# Altium schematic sheet GridSeed.SchDoc (part 1 of 2) (continued)
## Parts (continued)
C278  DB_VALUE: 470nF  [SMD_0603_CAPC1608X95N]
C279  DB_VALUE: 470nF  [SMD_0603_CAPC1608X95N]
C280  DB_VALUE: 470nF  [SMD_0603_CAPC1608X95N]
C281  DB_VALUE: 470nF  [SMD_0603_CAPC1608X95N]
C282  DB_VALUE: 470nF  [SMD_0603_CAPC1608X95N]
C283  DB_VALUE: 470nF  [SMD_0603_CAPC1608X95N]
C284  DB_VALUE: 470nF  [SMD_0603_CAPC1608X95N]
C285  DB_VALUE: 470nF  [SMD_0603_CAPC1608X95N]
C286  DB_VALUE: 470nF  [SMD_0603_CAPC1608X95N]
C287  DB_VALUE: 470nF  [SMD_0603_CAPC1608X95N]
C288  DB_VALUE: 470nF  [SMD_0603_CAPC1608X95N]
C289  DB_VALUE: 470nF  [SMD_0603_CAPC1608X95N]
C290  DB_VALUE: 470nF  [SMD_0603_CAPC1608X95N]
C291  DB_VALUE: 470nF  [SMD_0603_CAPC1608X95N]
C292  DB_VALUE: 2.2uF  DB_TOLERANCE: 5%  DB_VOLTAGE: 10V  [SMD_0805_CAPC2012X145N]
C293  DB_VALUE: 100pF  DB_TOLERANCE: 5%  DB_VOLTAGE: 50V  [SMD_0805_CAPC2012X145N]
C294  DB_VALUE: 47pF  DB_TOLERANCE: 5%  DB_VOLTAGE: 50V  [SMD_0805_CAPC2012X145N]
C295  DB_VALUE: 22pF  DB_TOLERANCE: 5%  DB_VOLTAGE: 50V  [SMD_0805_CAPC2012X145N]
C296  DB_VALUE: 2.2uF  DB_TOLERANCE: 5%  DB_VOLTAGE: 10V  [SMD_0805_CAPC2012X145N]
C297  DB_VALUE: 100pF  DB_TOLERANCE: 5%  DB_VOLTAGE: 50V  [SMD_0805_CAPC2012X145N]
C298  DB_VALUE: 47pF  DB_TOLERANCE: 5%  DB_VOLTAGE: 50V  [SMD_0805_CAPC2012X145N]
C299  DB_VALUE: 22pF  DB_TOLERANCE: 5%  DB_VOLTAGE: 50V  [SMD_0805_CAPC2012X145N]
C300  DB_VALUE: 2.2uF  DB_TOLERANCE: 5%  DB_VOLTAGE: 10V  [SMD_0805_CAPC2012X145N]
C301  DB_VALUE: 100pF  DB_TOLERANCE: 5%  DB_VOLTAGE: 50V  [SMD_0805_CAPC2012X145N]
C302  DB_VALUE: 47pF  DB_TOLERANCE: 5%  DB_VOLTAGE: 50V  [SMD_0805_CAPC2012X145N]
C303  DB_VALUE: 22pF  DB_TOLERANCE: 5%  DB_VOLTAGE: 50V  [SMD_0805_CAPC2012X145N]
C304  DB_VALUE: 2.2uF  DB_TOLERANCE: 5%  DB_VOLTAGE: 10V  [SMD_0805_CAPC2012X145N]
C305  DB_VALUE: 100pF  DB_TOLERANCE: 5%  DB_VOLTAGE: 50V  [SMD_0805_CAPC2012X145N]
C306  DB_VALUE: 47pF  DB_TOLERANCE: 5%  DB_VOLTAGE: 50V  [SMD_0805_CAPC2012X145N]
C307  DB_VALUE: 22pF  DB_TOLERANCE: 5%  DB_VOLTAGE: 50V  [SMD_0805_CAPC2012X145N]
C308  DB_VALUE: 2.2uF  DB_TOLERANCE: 5%  DB_VOLTAGE: 10V  [SMD_0805_CAPC2012X145N]
C309  DB_VALUE: 100pF  DB_TOLERANCE: 5%  DB_VOLTAGE: 50V  [SMD_0805_CAPC2012X145N]
C310  DB_VALUE: 47pF  DB_TOLERANCE: 5%  DB_VOLTAGE: 50V  [SMD_0805_CAPC2012X145N]
C311  DB_VALUE: 22pF  DB_TOLERANCE: 5%  DB_VOLTAGE: 50V  [SMD_0805_CAPC2012X145N]
C312  DB_VALUE: 2.2uF  DB_TOLERANCE: 5%  DB_VOLTAGE: 10V  [SMD_0805_CAPC2012X145N]
C313  DB_VALUE: 100pF  DB_TOLERANCE: 5%  DB_VOLTAGE: 50V  [SMD_0805_CAPC2012X145N]
C314  DB_VALUE: 47pF  DB_TOLERANCE: 5%  DB_VOLTAGE: 50V  [SMD_0805_CAPC2012X145N]
C315  DB_VALUE: 22pF  DB_TOLERANCE: 5%  DB_VOLTAGE: 50V  [SMD_0805_CAPC2012X145N]
C316  DB_VALUE: 2.2uF  DB_TOLERANCE: 5%  DB_VOLTAGE: 10V  [SMD_0805_CAPC2012X145N]
C317  DB_VALUE: 100pF  DB_TOLERANCE: 5%  DB_VOLTAGE: 50V  [SMD_0805_CAPC2012X145N]
C318  DB_VALUE: 47pF  DB_TOLERANCE: 5%  DB_VOLTAGE: 50V  [SMD_0805_CAPC2012X145N]
C319  DB_VALUE: 22pF  DB_TOLERANCE: 5%  DB_VOLTAGE: 50V  [SMD_0805_CAPC2012X145N]
C320  DB_VALUE: 2.2uF  DB_TOLERANCE: 5%  DB_VOLTAGE: 10V  [SMD_0805_CAPC2012X145N]
C321  DB_VALUE: 100pF  DB_TOLERANCE: 5%  DB_VOLTAGE: 50V  [SMD_0805_CAPC2012X145N]
C322  DB_VALUE: 47pF  DB_TOLERANCE: 5%  DB_VOLTAGE: 50V  [SMD_0805_CAPC2012X145N]
C323  DB_VALUE: 22pF  DB_TOLERANCE: 5%  DB_VOLTAGE: 50V  [SMD_0805_CAPC2012X145N]
C324  DB_VALUE: 470nF  [SMD_0603_CAPC1608X95N]
C325  DB_VALUE: 470nF  [SMD_0603_CAPC1608X95N]
C326  DB_VALUE: 470nF  [SMD_0603_CAPC1608X95N]
C327  DB_VALUE: 470nF  [SMD_0603_CAPC1608X95N]
C328  DB_VALUE: 470nF  [SMD_0603_CAPC1608X95N]
C329  DB_VALUE: 470nF  [SMD_0603_CAPC1608X95N]
C330  DB_VALUE: 470nF  [SMD_0603_CAPC1608X95N]
C331  DB_VALUE: 470nF  [SMD_0603_CAPC1608X95N]
C332  DB_VALUE: 470nF  [SMD_0603_CAPC1608X95N]
C333  DB_VALUE: 470nF  [SMD_0603_CAPC1608X95N]
C334  DB_VALUE: 470nF  [SMD_0603_CAPC1608X95N]
C335  DB_VALUE: 470nF  [SMD_0603_CAPC1608X95N]
C336  DB_VALUE: 470nF  [SMD_0603_CAPC1608X95N]
C337  DB_VALUE: 470nF  [SMD_0603_CAPC1608X95N]
C338  DB_VALUE: 470nF  [SMD_0603_CAPC1608X95N]
C339  DB_VALUE: 470nF  [SMD_0603_CAPC1608X95N]
C340  DB_VALUE: 470nF  [SMD_0603_CAPC1608X95N]
C341  DB_VALUE: 470nF  [SMD_0603_CAPC1608X95N]
C342  DB_VALUE: 470nF  [SMD_0603_CAPC1608X95N]
C343  DB_VALUE: 470nF  [SMD_0603_CAPC1608X95N]
C344  DB_VALUE: 470nF  [SMD_0603_CAPC1608X95N]
C345  DB_VALUE: 470nF  [SMD_0603_CAPC1608X95N]
C346  DB_VALUE: 470nF  [SMD_0603_CAPC1608X95N]
C347  DB_VALUE: 470nF  [SMD_0603_CAPC1608X95N]
C348  DB_VALUE: 470nF  [SMD_0603_CAPC1608X95N]
C349  DB_VALUE: 470nF  [SMD_0603_CAPC1608X95N]
C350  DB_VALUE: 470nF  [SMD_0603_CAPC1608X95N]
C351  DB_VALUE: 470nF  [SMD_0603_CAPC1608X95N]
C352  DB_VALUE: 470nF  [SMD_0603_CAPC1608X95N]
C353  DB_VALUE: 470nF  [SMD_0603_CAPC1608X95N]
C354  DB_VALUE: 470nF  [SMD_0603_CAPC1608X95N]
C355  DB_VALUE: 470nF  [SMD_0603_CAPC1608X95N]
C356  DB_VALUE: 470nF  [SMD_0603_CAPC1608X95N]
C357  DB_VALUE: 470nF  [SMD_0603_CAPC1608X95N]
C358  DB_VALUE: 470nF  [SMD_0603_CAPC1608X95N]
C359  DB_VALUE: 470nF  [SMD_0603_CAPC1608X95N]
C360  DB_VALUE: 470nF  [SMD_0603_CAPC1608X95N]
C361  DB_VALUE: 470nF  [SMD_0603_CAPC1608X95N]
C362  DB_VALUE: 470nF  [SMD_0603_CAPC1608X95N]
C363  DB_VALUE: 470nF  [SMD_0603_CAPC1608X95N]
C364  DB_VALUE: 470nF  [SMD_0603_CAPC1608X95N]
C365  DB_VALUE: 470nF  [SMD_0603_CAPC1608X95N]
C366  DB_VALUE: 470nF  [SMD_0603_CAPC1608X95N]
C367  DB_VALUE: 470nF  [SMD_0603_CAPC1608X95N]
C368  DB_VALUE: 470nF  [SMD_0603_CAPC1608X95N]
C369  DB_VALUE: 470nF  [SMD_0603_CAPC1608X95N]
C370  DB_VALUE: 470nF  [SMD_0603_CAPC1608X95N]
C371  DB_VALUE: 470nF  [SMD_0603_CAPC1608X95N]
C372  DB_VALUE: 470nF  [SMD_0603_CAPC1608X95N]
C373  DB_VALUE: 470nF  [SMD_0603_CAPC1608X95N]
C374  DB_VALUE: 470nF  [SMD_0603_CAPC1608X95N]
C375  DB_VALUE: 470nF  [SMD_0603_CAPC1608X95N]
C376  DB_VALUE: 470nF  [SMD_0603_CAPC1608X95N]
C377  DB_VALUE: 470nF  [SMD_0603_CAPC1608X95N]
C378  DB_VALUE: 470nF  [SMD_0603_CAPC1608X95N]
C379  DB_VALUE: 470nF  [SMD_0603_CAPC1608X95N]
C380  DB_VALUE: 470nF  [SMD_0603_CAPC1608X95N]
C381  DB_VALUE: 470nF  [SMD_0603_CAPC1608X95N]
C382  DB_VALUE: 470nF  [SMD_0603_CAPC1608X95N]
C383  DB_VALUE: 470nF  [SMD_0603_CAPC1608X95N]
C384  DB_VALUE: 2.2uF  DB_TOLERANCE: 5%  DB_VOLTAGE: 10V  [SMD_0805_CAPC2012X145N]
C385  DB_VALUE: 100pF  DB_TOLERANCE: 5%  DB_VOLTAGE: 50V  [SMD_0805_CAPC2012X145N]
C386  DB_VALUE: 47pF  DB_TOLERANCE: 5%  DB_VOLTAGE: 50V  [SMD_0805_CAPC2012X145N]
C387  DB_VALUE: 22pF  DB_TOLERANCE: 5%  DB_VOLTAGE: 50V  [SMD_0805_CAPC2012X145N]
C388  DB_VALUE: 2.2uF  DB_TOLERANCE: 5%  DB_VOLTAGE: 10V  [SMD_0805_CAPC2012X145N]
C389  DB_VALUE: 100pF  DB_TOLERANCE: 5%  DB_VOLTAGE: 50V  [SMD_0805_CAPC2012X145N]
C390  DB_VALUE: 47pF  DB_TOLERANCE: 5%  DB_VOLTAGE: 50V  [SMD_0805_CAPC2012X145N]
C391  DB_VALUE: 22pF  DB_TOLERANCE: 5%  DB_VOLTAGE: 50V  [SMD_0805_CAPC2012X145N]
C392  DB_VALUE: 2.2uF  DB_TOLERANCE: 5%  DB_VOLTAGE: 10V  [SMD_0805_CAPC2012X145N]
C393  DB_VALUE: 100pF  DB_TOLERANCE: 5%  DB_VOLTAGE: 50V  [SMD_0805_CAPC2012X145N]
C394  DB_VALUE: 47pF  DB_TOLERANCE: 5%  DB_VOLTAGE: 50V  [SMD_0805_CAPC2012X145N]
C395  DB_VALUE: 22pF  DB_TOLERANCE: 5%  DB_VOLTAGE: 50V  [SMD_0805_CAPC2012X145N]
C396  DB_VALUE: 2.2uF  DB_TOLERANCE: 5%  DB_VOLTAGE: 10V  [SMD_0805_CAPC2012X145N]
C397  DB_VALUE: 100pF  DB_TOLERANCE: 5%  DB_VOLTAGE: 50V  [SMD_0805_CAPC2012X145N]
C398  DB_VALUE: 47pF  DB_TOLERANCE: 5%  DB_VOLTAGE: 50V  [SMD_0805_CAPC2012X145N]
C399  DB_VALUE: 22pF  DB_TOLERANCE: 5%  DB_VOLTAGE: 50V  [SMD_0805_CAPC2012X145N]
C400  DB_VALUE: 2.2uF  DB_TOLERANCE: 5%  DB_VOLTAGE: 10V  [SMD_0805_CAPC2012X145N]
C401  DB_VALUE: 100pF  DB_TOLERANCE: 5%  DB_VOLTAGE: 50V  [SMD_0805_CAPC2012X145N]
C402  DB_VALUE: 47pF  DB_TOLERANCE: 5%  DB_VOLTAGE: 50V  [SMD_0805_CAPC2012X145N]
C403  DB_VALUE: 22pF  DB_TOLERANCE: 5%  DB_VOLTAGE: 50V  [SMD_0805_CAPC2012X145N]
C404  DB_VALUE: 2.2uF  DB_TOLERANCE: 5%  DB_VOLTAGE: 10V  [SMD_0805_CAPC2012X145N]
C405  DB_VALUE: 100pF  DB_TOLERANCE: 5%  DB_VOLTAGE: 50V  [SMD_0805_CAPC2012X145N]
C406  DB_VALUE: 47pF  DB_TOLERANCE: 5%  DB_VOLTAGE: 50V  [SMD_0805_CAPC2012X145N]
C407  DB_VALUE: 22pF  DB_TOLERANCE: 5%  DB_VOLTAGE: 50V  [SMD_0805_CAPC2012X145N]
C408  DB_VALUE: 2.2uF  DB_TOLERANCE: 5%  DB_VOLTAGE: 10V  [SMD_0805_CAPC2012X145N]
C409  DB_VALUE: 100pF  DB_TOLERANCE: 5%  DB_VOLTAGE: 50V  [SMD_0805_CAPC2012X145N]
C410  DB_VALUE: 47pF  DB_TOLERANCE: 5%  DB_VOLTAGE: 50V  [SMD_0805_CAPC2012X145N]
C411  DB_VALUE: 22pF  DB_TOLERANCE: 5%  DB_VOLTAGE: 50V  [SMD_0805_CAPC2012X145N]
C412  DB_VALUE: 2.2uF  DB_TOLERANCE: 5%  DB_VOLTAGE: 10V  [SMD_0805_CAPC2012X145N]
C413  DB_VALUE: 100pF  DB_TOLERANCE: 5%  DB_VOLTAGE: 50V  [SMD_0805_CAPC2012X145N]
C414  DB_VALUE: 47pF  DB_TOLERANCE: 5%  DB_VOLTAGE: 50V  [SMD_0805_CAPC2012X145N]
C415  DB_VALUE: 22pF  DB_TOLERANCE: 5%  DB_VOLTAGE: 50V  [SMD_0805_CAPC2012X145N]
C_1  DB_VALUE: 220uF  DB_TOLERANCE: 20%  DB_VOLTAGE: 6.3V  [SMD_1210_CAPC3225X270N]
C_2  DB_VALUE: 220uF  DB_TOLERANCE: 20%  DB_VOLTAGE: 6.3V  [SMD_1210_CAPC3225X270N]
C_3  DB_VALUE: 220uF  DB_TOLERANCE: 20%  DB_VOLTAGE: 6.3V  [SMD_1210_CAPC3225X270N]
C_4  DB_VALUE: 220uF  DB_TOLERANCE: 20%  DB_VOLTAGE: 6.3V  [SMD_1210_CAPC3225X270N]
C_5  DB_VALUE: 220uF  DB_TOLERANCE: 20%  DB_VOLTAGE: 6.3V  [SMD_1210_CAPC3225X270N]
C_6  DB_VALUE: 220uF  DB_TOLERANCE: 20%  DB_VOLTAGE: 6.3V  [SMD_1210_CAPC3225X270N]
C_7  DB_VALUE: 220uF  DB_TOLERANCE: 20%  DB_VOLTAGE: 6.3V  [SMD_1210_CAPC3225X270N]
C_8  DB_VALUE: 220uF  DB_TOLERANCE: 20%  DB_VOLTAGE: 6.3V  [SMD_1210_CAPC3225X270N]
C_9  DB_VALUE: 220uF  DB_TOLERANCE: 20%  DB_VOLTAGE: 6.3V  [SMD_1210_CAPC3225X270N]
C_10  DB_VALUE: 220uF  DB_TOLERANCE: 20%  DB_VOLTAGE: 6.3V  [SMD_1210_CAPC3225X270N]
C_11  DB_VALUE: 220uF  DB_TOLERANCE: 20%  DB_VOLTAGE: 6.3V  [SMD_1210_CAPC3225X270N]
C_12  DB_VALUE: 220uF  DB_TOLERANCE: 20%  DB_VOLTAGE: 6.3V  [SMD_1210_CAPC3225X270N]
C_13  DB_VALUE: 220uF  DB_TOLERANCE: 20%  DB_VOLTAGE: 6.3V  [SMD_1210_CAPC3225X270N]
C_14  DB_VALUE: 220uF  DB_TOLERANCE: 20%  DB_VOLTAGE: 6.3V  [SMD_1210_CAPC3225X270N]
C_15  DB_VALUE: 220uF  DB_TOLERANCE: 20%  DB_VOLTAGE: 6.3V  [SMD_1210_CAPC3225X270N]
C_16  DB_VALUE: 220uF  DB_TOLERANCE: 20%  DB_VOLTAGE: 6.3V  [SMD_1210_CAPC3225X270N]
C_17  DB_VALUE: 220uF  DB_TOLERANCE: 20%  DB_VOLTAGE: 6.3V  [SMD_1210_CAPC3225X270N]
C_18  DB_VALUE: 220uF  DB_TOLERANCE: 20%  DB_VOLTAGE: 6.3V  [SMD_1210_CAPC3225X270N]
C_19  DB_VALUE: 220uF  DB_TOLERANCE: 20%  DB_VOLTAGE: 6.3V  [SMD_1210_CAPC3225X270N]
C_20  DB_VALUE: 220uF  DB_TOLERANCE: 20%  DB_VOLTAGE: 6.3V  [SMD_1210_CAPC3225X270N]
C_21  DB_VALUE: 220uF  DB_TOLERANCE: 20%  DB_VOLTAGE: 6.3V  [SMD_1210_CAPC3225X270N]
C_22  DB_VALUE: 220uF  DB_TOLERANCE: 20%  DB_VOLTAGE: 6.3V  [SMD_1210_CAPC3225X270N]
C_23  DB_VALUE: 220uF  DB_TOLERANCE: 20%  DB_VOLTAGE: 6.3V  [SMD_1210_CAPC3225X270N]
C_24  DB_VALUE: 220uF  DB_TOLERANCE: 20%  DB_VOLTAGE: 6.3V  [SMD_1210_CAPC3225X270N]
C_25  DB_VALUE: 220uF  DB_TOLERANCE: 20%  DB_VOLTAGE: 6.3V  [SMD_1210_CAPC3225X270N]
C_26  DB_VALUE: 220uF  DB_TOLERANCE: 20%  DB_VOLTAGE: 6.3V  [SMD_1210_CAPC3225X270N]
C_27  DB_VALUE: 220uF  DB_TOLERANCE: 20%  DB_VOLTAGE: 6.3V  [SMD_1210_CAPC3225X270N]
C_28  DB_VALUE: 220uF  DB_TOLERANCE: 20%  DB_VOLTAGE: 6.3V  [SMD_1210_CAPC3225X270N]
C_29  DB_VALUE: 220uF  DB_TOLERANCE: 20%  DB_VOLTAGE: 6.3V  [SMD_1210_CAPC3225X270N]
C_30  DB_VALUE: 220uF  DB_TOLERANCE: 20%  DB_VOLTAGE: 6.3V  [SMD_1210_CAPC3225X270N]
C_31  DB_VALUE: 220uF  DB_TOLERANCE: 20%  DB_VOLTAGE: 6.3V  [SMD_1210_CAPC3225X270N]
C_32  DB_VALUE: 220uF  DB_TOLERANCE: 20%  DB_VOLTAGE: 6.3V  [SMD_1210_CAPC3225X270N]
C_33  DB_VALUE: 220uF  DB_TOLERANCE: 20%  DB_VOLTAGE: 6.3V  [SMD_1210_CAPC3225X270N]
C_34  DB_VALUE: 220uF  DB_TOLERANCE: 20%  DB_VOLTAGE: 6.3V  [SMD_1210_CAPC3225X270N]
C_35  DB_VALUE: 220uF  DB_TOLERANCE: 20%  DB_VOLTAGE: 6.3V  [SMD_1210_CAPC3225X270N]
C_36  DB_VALUE: 220uF  DB_TOLERANCE: 20%  DB_VOLTAGE: 6.3V  [SMD_1210_CAPC3225X270N]
C_37  DB_VALUE: 220uF  DB_TOLERANCE: 20%  DB_VOLTAGE: 6.3V  [SMD_1210_CAPC3225X270N]
C_38  DB_VALUE: 220uF  DB_TOLERANCE: 20%  DB_VOLTAGE: 6.3V  [SMD_1210_CAPC3225X270N]
C_39  DB_VALUE: 220uF  DB_TOLERANCE: 20%  DB_VOLTAGE: 6.3V  [SMD_1210_CAPC3225X270N]
C_40  DB_VALUE: 220uF  DB_TOLERANCE: 20%  DB_VOLTAGE: 6.3V  [SMD_1210_CAPC3225X270N]
C_41  DB_VALUE: 220uF  DB_TOLERANCE: 20%  DB_VOLTAGE: 6.3V  [SMD_1210_CAPC3225X270N]
C_42  DB_VALUE: 220uF  DB_TOLERANCE: 20%  DB_VOLTAGE: 6.3V  [SMD_1210_CAPC3225X270N]
C_43  DB_VALUE: 220uF  DB_TOLERANCE: 20%  DB_VOLTAGE: 6.3V  [SMD_1210_CAPC3225X270N]
C_44  DB_VALUE: 220uF  DB_TOLERANCE: 20%  DB_VOLTAGE: 6.3V  [SMD_1210_CAPC3225X270N]
C_45  DB_VALUE: 220uF  DB_TOLERANCE: 20%  DB_VOLTAGE: 6.3V  [SMD_1210_CAPC3225X270N]
C_46  DB_VALUE: 220uF  DB_TOLERANCE: 20%  DB_VOLTAGE: 6.3V  [SMD_1210_CAPC3225X270N]
C_47  DB_VALUE: 220uF  DB_TOLERANCE: 20%  DB_VOLTAGE: 6.3V  [SMD_1210_CAPC3225X270N]
C_48  DB_VALUE: 220uF  DB_TOLERANCE: 20%  DB_VOLTAGE: 6.3V  [SMD_1210_CAPC3225X270N]
C_49  DB_VALUE: 220uF  DB_TOLERANCE: 20%  DB_VOLTAGE: 6.3V  [SMD_1210_CAPC3225X270N]
C_50  DB_VALUE: 220uF  DB_TOLERANCE: 20%  DB_VOLTAGE: 6.3V  [SMD_1210_CAPC3225X270N]
C_51  DB_VALUE: 220uF  DB_TOLERANCE: 20%  DB_VOLTAGE: 6.3V  [SMD_1210_CAPC3225X270N]
C_52  DB_VALUE: 220uF  DB_TOLERANCE: 20%  DB_VOLTAGE: 6.3V  [SMD_1210_CAPC3225X270N]
C_53  DB_VALUE: 220uF  DB_TOLERANCE: 20%  DB_VOLTAGE: 6.3V  [SMD_1210_CAPC3225X270N]
C_54  DB_VALUE: 220uF  DB_TOLERANCE: 20%  DB_VOLTAGE: 6.3V  [SMD_1210_CAPC3225X270N]
C_55  DB_VALUE: 220uF  DB_TOLERANCE: 20%  DB_VOLTAGE: 6.3V  [SMD_1210_CAPC3225X270N]
C_56  DB_VALUE: 220uF  DB_TOLERANCE: 20%  DB_VOLTAGE: 6.3V  [SMD_1210_CAPC3225X270N]
C_57  DB_VALUE: 220uF  DB_TOLERANCE: 20%  DB_VOLTAGE: 6.3V  [SMD_1210_CAPC3225X270N]
C_58  DB_VALUE: 220uF  DB_TOLERANCE: 20%  DB_VOLTAGE: 6.3V  [SMD_1210_CAPC3225X270N]
C_59  DB_VALUE: 220uF  DB_TOLERANCE: 20%  DB_VOLTAGE: 6.3V  [SMD_1210_CAPC3225X270N]
C_60  DB_VALUE: 220uF  DB_TOLERANCE: 20%  DB_VOLTAGE: 6.3V  [SMD_1210_CAPC3225X270N]
C_61  DB_VALUE: 220uF  DB_TOLERANCE: 20%  DB_VOLTAGE: 6.3V  [SMD_1210_CAPC3225X270N]
C_62  DB_VALUE: 220uF  DB_TOLERANCE: 20%  DB_VOLTAGE: 6.3V  [SMD_1210_CAPC3225X270N]
C_63  DB_VALUE: 220uF  DB_TOLERANCE: 20%  DB_VOLTAGE: 6.3V  [SMD_1210_CAPC3225X270N]
C_64  DB_VALUE: 220uF  DB_TOLERANCE: 20%  DB_VOLTAGE: 6.3V  [SMD_1210_CAPC3225X270N]
C_65  DB_VALUE: 220uF  DB_TOLERANCE: 20%  DB_VOLTAGE: 6.3V  [SMD_1210_CAPC3225X270N]
C_66  DB_VALUE: 220uF  DB_TOLERANCE: 20%  DB_VOLTAGE: 6.3V  [SMD_1210_CAPC3225X270N]
C_67  DB_VALUE: 220uF  DB_TOLERANCE: 20%  DB_VOLTAGE: 6.3V  [SMD_1210_CAPC3225X270N]
C_68  DB_VALUE: 220uF  DB_TOLERANCE: 20%  DB_VOLTAGE: 6.3V  [SMD_1210_CAPC3225X270N]
C_69  DB_VALUE: 220uF  DB_TOLERANCE: 20%  DB_VOLTAGE: 6.3V  [SMD_1210_CAPC3225X270N]
C_70  DB_VALUE: 220uF  DB_TOLERANCE: 20%  DB_VOLTAGE: 6.3V  [SMD_1210_CAPC3225X270N]
C_71  DB_VALUE: 220uF  DB_TOLERANCE: 20%  DB_VOLTAGE: 6.3V  [SMD_1210_CAPC3225X270N]
C_72  DB_VALUE: 220uF  DB_TOLERANCE: 20%  DB_VOLTAGE: 6.3V  [SMD_1210_CAPC3225X270N]
D1  BAT54C  [SMD_SOT23_SOT95P240X120-3N]
D2  BAT54C  [SMD_SOT23_SOT95P240X120-3N]
D3  BAT54C  [SMD_SOT23_SOT95P240X120-3N]
D4  Red SML210VT ROHM  [SMD_0805_LED2012X100N]
D5  Green 	SML210MT ROHM  [SMD_0805_LED2012X100N]
D6  Yellow SML210YT ROHM  [SMD_0805_LED2012X100N]
D7  Orange 	SML210DT ROHM  [SMD_0805_LED2012X100N]
D8  (OPT)SS14  DB_VALUE: B140  [SMD_DO214AC_SMA]
D9  SMS05T1G  [SMD_SOT457_SOT95P275X110-6N]
D10  (OPT)SS14  DB_VALUE: B140  [SMD_DO214AC_SMA]
D11  SS14  DB_VALUE: B140  [SMD_DO214AC_SMA]
D12  D_TVS_UNI  DB_VALUE: SMCJ12A  [SMD_DO214AC_SMC]
FB1  L_FERRITE_BEAD  DB_VALUE: 220 Ohms  DB_CURRENT: 2A  [SMD_0805_INDC2012X105N]
J1  CON_5PINS  DB_VALUE: CONN PCB 5P M S  [PTH_HDRV05W64P254_1X05]
J2  CU04SCM15B0-R0  DB_VALUE: USB MINI  [SMD_CON-CVILUX-CU04-SCM15B0]
J3  DB_VALUE: HD-351-3P  [PTH_CON_HD-351-3P]
J4  CON_2ROWS_6PINS_1  DB_VALUE: WR-MPC4  [PTH_CON_WR-MRC4-6P]
L1  SLC1480-201MLD  [SMT_INDM135130X800N]
L2  SLC1480-201MLD  [SMT_INDM135130X800N]
L3  SLC1480-201MLD  [SMT_INDM135130X800N]
Q1  AP1RA03GMT-3  DB_VALUE: AP1RA03GMT-HF-3  [SMD_QFN127P500X600X90-8N]
Q2  AP1RA03GMT-3  DB_VALUE: AP1RA03GMT-HF-3  [SMD_QFN127P500X600X90-8N]
Q3  AP1RA03GMT-3  DB_VALUE: AP1RA03GMT-HF-3  [SMD_QFN127P500X600X90-8N]
Q4  AP1RA03GMT-3  DB_VALUE: AP1RA03GMT-HF-3  [SMD_QFN127P500X600X90-8N]
Q5  AP1RA03GMT-3  DB_VALUE: AP1RA03GMT-HF-3  [SMD_QFN127P500X600X90-8N]
Q6  AP1RA03GMT-3  DB_VALUE: AP1RA03GMT-HF-3  [SMD_QFN127P500X600X90-8N]
Q7  AP1RA03GMT-3  DB_VALUE: AP1RA03GMT-HF-3  [SMD_QFN127P500X600X90-8N]
Q8  AP1RA03GMT-3  DB_VALUE: AP1RA03GMT-HF-3  [SMD_QFN127P500X600X90-8N]
Q9  AP1RA03GMT-3  DB_VALUE: AP1RA03GMT-HF-3  [SMD_QFN127P500X600X90-8N]
R1  DB_VALUE: 10k  DB_TOLERANCE: 1%  [SMD_0603_RESC1608X55N]
R2  DB_VALUE: 10k  DB_TOLERANCE: 1%  [SMD_0603_RESC1608X55N]
R3  DB_VALUE: 10k  DB_TOLERANCE: 1%  [SMD_0603_RESC1608X55N]
R4  DB_VALUE: 10k  DB_TOLERANCE: 1%  [SMD_0603_RESC1608X55N]
R5  DB_VALUE: 10k  DB_TOLERANCE: 1%  [SMD_0603_RESC1608X55N]
R6  DB_VALUE: 10k  DB_TOLERANCE: 1%  [SMD_0603_RESC1608X55N]
R7  DB_VALUE: 10k  DB_TOLERANCE: 1%  [SMD_0603_RESC1608X55N]
R8  DB_VALUE: 10k  DB_TOLERANCE: 1%  [SMD_0603_RESC1608X55N]
R9  DB_VALUE: 1.02R  DB_TOLERANCE: 1%  [SMD_0603_RESC1608X55N]
R10  DB_VALUE: 1.02R  DB_TOLERANCE: 1%  [SMD_0603_RESC1608X55N]
R11  DB_VALUE: 1.02R  DB_TOLERANCE: 1%  [SMD_0603_RESC1608X55N]
R12  DB_VALUE: 1.02R  DB_TOLERANCE: 1%  [SMD_0603_RESC1608X55N]
R13  DB_VALUE: 1.02R  DB_TOLERANCE: 1%  [SMD_0603_RESC1608X55N]
R14  DB_VALUE: 1.02R  DB_TOLERANCE: 1%  [SMD_0603_RESC1608X55N]
R15  DB_VALUE: 1.02R  DB_TOLERANCE: 1%  [SMD_0603_RESC1608X55N]
R16  DB_VALUE: 1.02R  DB_TOLERANCE: 1%  [SMD_0603_RESC1608X55N]
R17  DB_VALUE: 10k  DB_TOLERANCE: 1%  [SMD_0603_RESC1608X55N]
R18  DB_VALUE: 10k  DB_TOLERANCE: 1%  [SMD_0603_RESC1608X55N]
R19  DB_VALUE: 10k  DB_TOLERANCE: 1%  [SMD_0603_RESC1608X55N]
R20  DB_VALUE: 10k  DB_TOLERANCE: 1%  [SMD_0603_RESC1608X55N]
R21  DB_VALUE: 10k  DB_TOLERANCE: 1%  [SMD_0603_RESC1608X55N]
R22  DB_VALUE: 10k  DB_TOLERANCE: 1%  [SMD_0603_RESC1608X55N]
R23  DB_VALUE: 10k  DB_TOLERANCE: 1%  [SMD_0603_RESC1608X55N]
R24  DB_VALUE: 10k  DB_TOLERANCE: 1%  [SMD_0603_RESC1608X55N]
R25  DB_VALUE: 2.4k  DB_TOLERANCE: 1%  [SMD_0603_RESC1608X55N]
R26  DB_VALUE: 10k  [SMD_0603_RESC1608X55N]
R27  DB_VALUE: 47R  DB_TOLERANCE: 1%  [SMD_0603_RESC1608X55N]
R28  DB_VALUE: 10k  [SMD_0603_RESC1608X55N]
R29  DB_VALUE: 10k  [SMD_0603_RESC1608X55N]
R30  DB_VALUE: 47R  DB_TOLERANCE: 1%  [SMD_0603_RESC1608X55N]
R31  DB_VALUE: 10k  DB_TOLERANCE: 1%  [SMD_0603_RESC1608X55N]
R32  DB_VALUE: 10k  DB_TOLERANCE: 1%  [SMD_0603_RESC1608X55N]
R33  DB_VALUE: 0R  DB_TOLERANCE: 1%  [SMD_0603_RESC1608X55N]
R34  DB_VALUE: 1.02R  DB_TOLERANCE: 1%  [SMD_0603_RESC1608X55N]
R35  DB_VALUE: 1.02R  DB_TOLERANCE: 1%  [SMD_0603_RESC1608X55N]
R36  DB_VALUE: 1.02R  DB_TOLERANCE: 1%  [SMD_0603_RESC1608X55N]
R37  DB_VALUE: 1.02R  DB_TOLERANCE: 1%  [SMD_0603_RESC1608X55N]
R38  DB_VALUE: 1.02R  DB_TOLERANCE: 1%  [SMD_0603_RESC1608X55N]
R39  DB_VALUE: 1.02R  DB_TOLERANCE: 1%  [SMD_0603_RESC1608X55N]
R40  DB_VALUE: 1.02R  DB_TOLERANCE: 1%  [SMD_0603_RESC1608X55N]
R41  DB_VALUE: 1.02R  DB_TOLERANCE: 1%  [SMD_0603_RESC1608X55N]
R42  DB_VALUE: 2R  DB_TOLERANCE: 5%  [SMD_1206_RESC3216X65N]
R43  DB_VALUE: 10k  DB_TOLERANCE: 1%  [SMD_0603_RESC1608X55N]
R44  DB_VALUE: 10k  DB_TOLERANCE: 1%  [SMD_0603_RESC1608X55N]
R45  DB_VALUE: 10k  DB_TOLERANCE: 1%  [SMD_0603_RESC1608X55N]
R46  DB_VALUE: 10k  DB_TOLERANCE: 1%  [SMD_0603_RESC1608X55N]
R47  DB_VALUE: 100R  DB_TOLERANCE: 1%  [SMD_1206_RESC3216X65N]
R48  DB_VALUE: 0R  DB_TOLERANCE: 1%  [SMD_1206_RESC3216X65N]
R49  OPT  DB_VALUE: 0R  DB_TOLERANCE: 1%  [SMD_1206_RESC3216X65N]
R50  DB_VALUE: 10k  DB_TOLERANCE: 1%  [SMD_0603_RESC1608X55N]
R51  DB_VALUE: 30k  DB_TOLERANCE: 1%  [SMD_0603_RESC1608X55N]
R52  DB_VALUE: 10k  DB_TOLERANCE: 1%  [SMD_0603_RESC1608X55N]
R53  DB_VALUE: 10k  DB_TOLERANCE: 1%  [SMD_0603_RESC1608X55N]
R54  DB_VALUE: 10k  DB_TOLERANCE: 1%  [SMD_0603_RESC1608X55N]
R55  DB_VALUE: 30k  DB_TOLERANCE: 1%  [SMD_0603_RESC1608X55N]
R56  DB_VALUE: 1.02R  DB_TOLERANCE: 1%  [SMD_0603_RESC1608X55N]
R57  DB_VALUE: 1.02R  DB_TOLERANCE: 1%  [SMD_0603_RESC1608X55N]
R58  DB_VALUE: 1.02R  DB_TOLERANCE: 1%  [SMD_0603_RESC1608X55N]
R59  DB_VALUE: 1.02R  DB_TOLERANCE: 1%  [SMD_0603_RESC1608X55N]
R60  DB_VALUE: 1.02R  DB_TOLERANCE: 1%  [SMD_0603_RESC1608X55N]
R61  DB_VALUE: 1.02R  DB_TOLERANCE: 1%  [SMD_0603_RESC1608X55N]
R62  DB_VALUE: 1.02R  DB_TOLERANCE: 1%  [SMD_0603_RESC1608X55N]
R63  DB_VALUE: 1.02R  DB_TOLERANCE: 1%  [SMD_0603_RESC1608X55N]
R64  DB_VALUE: 10k  DB_TOLERANCE: 1%  [SMD_0603_RESC1608X55N]
R65  DB_VALUE: 10k  DB_TOLERANCE: 1%  [SMD_0603_RESC1608X55N]
R66  DB_VALUE: 10k  DB_TOLERANCE: 1%  [SMD_0603_RESC1608X55N]
R67  DB_VALUE: 10k  DB_TOLERANCE: 1%  [SMD_0603_RESC1608X55N]
R68  DB_VALUE: 1.02R  DB_TOLERANCE: 1%  [SMD_0603_RESC1608X55N]
R69  DB_VALUE: 1.02R  DB_TOLERANCE: 1%  [SMD_0603_RESC1608X55N]
R70  DB_VALUE: 1.02R  DB_TOLERANCE: 1%  [SMD_0603_RESC1608X55N]
R71  DB_VALUE: 1.02R  DB_TOLERANCE: 1%  [SMD_0603_RESC1608X55N]
R72  DB_VALUE: 1.02R  DB_TOLERANCE: 1%  [SMD_0603_RESC1608X55N]
R73  DB_VALUE: 1.02R  DB_TOLERANCE: 1%  [SMD_0603_RESC1608X55N]
R74  DB_VALUE: 1.02R  DB_TOLERANCE: 1%  [SMD_0603_RESC1608X55N]
R75  DB_VALUE: 1.02R  DB_TOLERANCE: 1%  [SMD_0603_RESC1608X55N]
TP1  TEST_POINT_1  [SMD_TP_100-254]  (value not drawn)  (no BOM)
TP2  TEST_POINT_1  [SMD_TP_100-254]  (value not drawn)  (no BOM)
TP3  TEST_POINT_1  [SMD_TP_100-254]  (value not drawn)  (no BOM)
TP4  TEST_POINT_1  [SMD_TP_100-254]  (value not drawn)  (no BOM)
TP5  TEST_POINT_1  [SMD_TP_100-254]  (value not drawn)  (no BOM)
TP6  TEST_POINT_1  [SMD_TP_100-254]  (value not drawn)  (no BOM)
TP7  TEST_POINT_1  [SMD_TP_100-254]  (value not drawn)  (no BOM)
TP8  TEST_POINT_1  [SMD_TP_100-254]  (value not drawn)  (no BOM)
TP9  TEST_POINT_1  [SMD_TP_100-254]  (value not drawn)  (no BOM)
TP10  TEST_POINT_1  [SMD_TP_100-254]  (value not drawn)  (no BOM)
TP11  TEST_POINT_1  [SMD_TP_100-254]  (value not drawn)  (no BOM)
TP12  TEST_POINT_1  [SMD_TP_100-254]  (value not drawn)  (no BOM)
TP13  TEST_POINT_1  [SMD_TP_100-254]  (value not drawn)  (no BOM)
TP14  TEST_POINT_1  [SMD_TP_100-254]  (value not drawn)  (no BOM)
TP15  TEST_POINT_1  [SMD_TP_100-254]  (value not drawn)  (no BOM)
TP16  TEST_POINT_1  [SMD_TP_100-254]  (value not drawn)  (no BOM)
TP17  TEST_POINT_1  [SMD_TP_100-254]  (value not drawn)  (no BOM)
TP18  TEST_POINT_1  [SMD_TP_100-254]  (value not drawn)  (no BOM)
TP19  TEST_POINT_1  [SMD_TP_100-254]  (value not drawn)  (no BOM)
TP20  TEST_POINT_1  [SMD_TP_100-254]  (value not drawn)  (no BOM)
TP21  TEST_POINT_1  [SMD_TP_100-254]  (value not drawn)  (no BOM)
TP22  TEST_POINT_1  [SMD_TP_100-254]  (value not drawn)  (no BOM)
TP23  TEST_POINT_1  [SMD_TP_100-254]  (value not drawn)  (no BOM)
TP24  TEST_POINT_1  [SMD_TP_100-254]  (value not drawn)  (no BOM)
TP25  TEST_POINT_1  [SMD_TP_100-254]  (value not drawn)  (no BOM)
TP26  TEST_POINT_1  [SMD_TP_100-254]  (value not drawn)  (no BOM)
TP27  TEST_POINT_1  [SMD_TP_100-254]  (value not drawn)  (no BOM)
TP28  TEST_POINT_1  [SMD_TP_100-254]  (value not drawn)  (no BOM)
TP29  TEST_POINT_1  [SMD_TP_100-254]  (value not drawn)  (no BOM)
TP30  TEST_POINT_1  [SMD_TP_100-254]  (value not drawn)  (no BOM)
TP31  TEST_POINT_1  [SMD_TP_100-254]  (value not drawn)  (no BOM)
TP32  TEST_POINT_1  [SMD_TP_100-254]  (value not drawn)  (no BOM)
TP33  TEST_POINT_1  [SMD_TP_100-254]  (value not drawn)  (no BOM)
TP34  TEST_POINT_1  [SMD_TP_100-254]  (value not drawn)  (no BOM)
TP35  TEST_POINT_1  [SMD_TP_100-254]  (value not drawn)  (no BOM)
TP36  TEST_POINT_1  [SMD_TP_100-254]  (value not drawn)  (no BOM)
TP37  TEST_POINT_1  [SMD_TP_100-254]  (value not drawn)  (no BOM)
TP38  TEST_POINT_1  [SMD_TP_100-254]  (value not drawn)  (no BOM)
TP39  TEST_POINT_1  [SMD_TP_100-254]  (value not drawn)  (no BOM)
TP40  TEST_POINT_1  [SMD_TP_100-254]  (value not drawn)  (no BOM)
TP41  TEST_POINT_1  [SMD_TP_100-254]  (value not drawn)  (no BOM)
TP42  TEST_POINT_1  [SMD_TP_100-254]  (value not drawn)  (no BOM)
TP43  TEST_POINT_1  [SMD_TP_100-254]  (value not drawn)  (no BOM)
TP44  TEST_POINT_1  [SMD_TP_100-254]  (value not drawn)  (no BOM)
TP45  TEST_POINT_1  [SMD_TP_100-254]  (value not drawn)  (no BOM)
TP46  TEST_POINT_1  [SMD_TP_100-254]  (value not drawn)  (no BOM)
TP47  TEST_POINT_1  [SMD_TP_100-254]  (value not drawn)  (no BOM)
TP48  TEST_POINT_1  [SMD_TP_100-254]  (value not drawn)  (no BOM)
TP49  TEST_POINT_1  [SMD_TP_100-254]  (value not drawn)  (no BOM)
TP50  TEST_POINT_1  [SMD_TP_100-254]  (value not drawn)  (no BOM)
TP51  TEST_POINT_1  [SMD_TP_100-254]  (value not drawn)  (no BOM)
TP52  TEST_POINT_1  [SMD_TP_100-254]  (value not drawn)  (no BOM)
U1  IC_LTC4449  DB_VALUE: LTC4449EDCB#TRPBF  [SMT_SON45P300X200X80-9N]
U2  IC_LTC4449  DB_VALUE: LTC4449EDCB#TRPBF  [SMT_SON45P300X200X80-9N]
U3  IC_LTC4449  DB_VALUE: LTC4449EDCB#TRPBF  [SMT_SON45P300X200X80-9N]
U4  GC3355Q64  [SMT_QFN40P800X800X90-65N]
U5  GC3355Q64  [SMT_QFN40P800X800X90-65N]
U6  GC3355Q64  [SMT_QFN40P800X800X90-65N]
U7  GC3355Q64  [SMT_QFN40P800X800X90-65N]
U8  IC_DSPIC33EP256MU806-QFN64  DB_VALUE: dsPIC33EP256MU806  [SMD_QFP50P1200X1200X120-64N]
U9  GC3355Q64  [SMT_QFN40P800X800X90-65N]
U10  GC3355Q64  [SMT_QFN40P800X800X90-65N]
U11  GC3355Q64  [SMT_QFN40P800X800X90-65N]
U12  GC3355Q64  [SMT_QFN40P800X800X90-65N]
U13  (OPT) LM7805  DB_VALUE: AP78L05SG-13  [SMD_SOIC127P600X175-8N]
U14  IC_TLV70033QDDCRQ1  DB_VALUE: BU33TD3WG-TR  [SMD_SOT95P280X135-5N]
U15  BD33KA5WF  DB_VALUE: BD33KA5WF-E2  [SMD_SOIC127P600X175-8N]
U16  DB_VALUE: L7805CD2T-TR  [SMD_TO254P1420X457-3_4N]  (hidden comment: IC_IN1OUT3GND4)
U17  L78M05CDT-TR  DB_VALUE: MC78M05BDTRKG  [SMD_TO229P991X239-4N_DPAK]
U18  GC3355Q64  [SMT_QFN40P800X800X90-65N]
U19  GC3355Q64  [SMT_QFN40P800X800X90-65N]
U20  GC3355Q64  [SMT_QFN40P800X800X90-65N]
U21  GC3355Q64  [SMT_QFN40P800X800X90-65N]
U22  IC_BD00KA5WF  DB_VALUE: BD00KA5WF-E2  [SMD_SOIC127P600X175-8N]
U23  IC_BD00KA5WF  DB_VALUE: BD00KA5WF-E2  [SMD_SOIC127P600X175-8N]
U24  GC3355Q64  [SMT_QFN40P800X800X90-65N]
U25  GC3355Q64  [SMT_QFN40P800X800X90-65N]
U26  GC3355Q64  [SMT_QFN40P800X800X90-65N]
U27  GC3355Q64  [SMT_QFN40P800X800X90-65N]
Y1  4.00MHz HC49/4HSMX  [SMD_HC49_XTAL1140X480X420N]